# EAGLE board Mk4 Prototype (EAGLE 9.0.1), part 1 of 2 (continued)
## Placement (x,y rotation side) (continued)
FL1  DEA202450BT-1294C1-H  [DEA202450BT]  10.8,25.75 270 bottom
IC1  MSP432E401  [QFP128-0.4]  59.8,53 0 bottom
IC2  AS4C4M16SA-7TCN  [TSOP54-400]  38,52.7 270 bottom
IC3  TPS62822DLCR  [VSON-HR]  31.5,14.1 180 bottom
IC4  TCA9555RGER  [QFN-24]  78.05,26 270 bottom
IC5  SIM800C  [SIM800C]  100.3,41 180 bottom
IC6  SST26VF016B-104I/SM  [SO08-EIAJ]  72.5,43.15 270 bottom
IC7  TPD3E001DRL  [DRL-5]  69.8,69.25 180 bottom
IC8  BQ25601  [QFN-24]  41.05,24 270 bottom
IC9  OPT3001  [USON-6]  82.8,10.2 90 top
IC10  TPD3E001DRL  [DRL-5]  113.3,30.75 0 bottom
IC11  LMV358ID  [SO08]  79.8,54 180 bottom
IC12  SN74HC4066D  [SO14]  90.8,54.5 0 bottom
IC13  TPA2006D1  [VSON-8]  25.55,49 90 bottom
IC14  MX25R1635FM1IL0  [SO08-EIAJ]  12.05,40.25 90 bottom
IC15  CC3120R  [VQFN-64]  17.3,22.5 0 bottom
J1  78723-1001  [MSIM-MOLEX-LWK]  117.3,22.25 180 bottom
J2  ER-CON50HT-1  [FH12-50S-0.5SH]  59.8,33.5 0 bottom
J3  2x5 1.27mm  [PINHEAD_2X05_127]  89.7,62.2 0 bottom
J4  GSM-COIL-ANT  [GSM-ANTENNA]  116.3,36 0 bottom
J5  S2B-PH-SM4-TB(LF)(SN)  [JST-2-SMD]  88.6,15.8 90 bottom
JP2  1x03  [1X03_LOCK]  57.26,75.4 180 bottom
JP3  1x02 2MM  [1X02_2MM]  41.55,8.25 0 bottom
JP4  TC2030-MCP-NL  [TC2030-MCP-NL]  84.25,63.9 270 bottom
JP7  1x14  [1X14_LOCK]  2.05,59.5 270 bottom
JP8  1x04_1.27MM  [1X04-1.27MM]  10.55,14 180 top
JP9  1x04_1.27MM  [1X04-1.27MM]  113.3,49.5 0 bottom
L1  SRN2512-2R2M  [1008]  36.05,19.75 270 bottom
L2  BLM18KG121TN1D  [WUERTH-0805]  67.55,69.5 270 bottom
L3  0402/0R/5%  [L0402]  113.8,34.25 180 bottom
L4  DFE201610E-R47M=P2  [0806]  35.3,15.15 90 bottom
L5  0402/0R/5%  [L0402]  110.55,64 110 bottom
L6  0402/0R/5%  [L0402]  3.8,23 0 bottom
L7  LQM2HPN2R2MG0L  [1008]  14.3,33.2 180 bottom
L8  LQM2HPN1R0MG0L  [1008]  17.3,33.5 270 bottom
L9  LQM2HPN2R2MG0L  [1008]  23.8,32 270 bottom
LAYERS1  LAYER_NUMBRS_4_SMALL  [LAYER_NUMBERS_4_SMALL]  57.8,23.5 0 top
LCD  ER-TFT024-3  [ER-TFT024-3]  59.8,33.5 0 top
LED1  WS2812B  [WS2812B]  52.3,74 180 top
LED2  WS2812B  [WS2812B]  67.3,74 180 top
LED3  0603 RED  [LED-0603-CORRECT]  61.07,72 90 top
LED4  0603 GREEN  [LED-0603-CORRECT]  58.53,72 90 top
LED5  LED 5MM  [LED5MM]  33.8,10 0 top
LED6  0603 RED  [LED-0603-CORRECT]  43.55,28.75 180 bottom
LOGO1  EMFLOGO-BOTH  [EMFLOGO]  32.3,26 180 top
PCB  TiLDA Mk4 PCB  [TILDA_MK4_OUTLINE]  59.8,0 0 top
Q1  2N7002PW  [SC70-3-R]  90.3,29.5 90 bottom
Q2  2N7002PW  [SC70-3-R]  100.55,14 180 bottom
Q3  CSD25402Q3A  [Q3A]  39.55,15.75 0 bottom
Q8  CSD13202Q2  [Q2]  74.3,38.75 270 bottom
R1  0402/1K/5%  [R0402-SMALLER]  4.3,53 180 bottom
R2  0402/1K/5%  [R0402-SMALLER]  4.55,48 180 bottom
R3  0402/4K87/5%  [R0402-SMALLER]  49.8,57.25 0 bottom
R4  0402/10K/5%  [R0402-SMALLER]  58.3,65.25 180 bottom
R5  0402/1M/5%  [R0402-SMALLER]  49.8,59.25 0 bottom
R6  0402/2K/5%  [R0402-SMALLER]  63.55,63.75 90 bottom
R7  0402/1M/5%  [R0402-SMALLER]  65.3,72 270 bottom
R8  0402/100R/5%  [R0402-SMALLER]  70.8,67.25 270 bottom
R9  0402/10K/5%  [R0402-SMALLER]  67.3,44.25 270 bottom
R10  0402/10K/5%  [R0402-SMALLER]  77.8,41.75 90 bottom
R11  [0309/10]  23.3,12.25 180 top
R12  0402/2K/5%  [R0402-SMALLER]  61.07,72 270 bottom
R13  0402/10K/5%  [R0402-SMALLER]  37.55,15.25 90 bottom
R14  0402/4K7/5%  [R0402-SMALLER]  58.53,72 270 bottom
R15  0402/10K/5%  [R0402-SMALLER]  45.55,23.25 0 bottom
R16  0402/10K/5%  [R0402-SMALLER]  45.55,22.25 180 bottom
R17  0402/2K/5%  [R0402-SMALLER]  45.55,24.25 180 bottom
R18  0402/10K/5%  [R0402-SMALLER]  41.05,30.5 180 bottom
R19  0402/10K/5%  [R0402-SMALLER]  41.05,29.5 180 bottom
R20  0402/10K/5%  [R0402-SMALLER]  41.55,28 90 bottom
R21  0402/4K7/5%  [R0402-SMALLER]  45.85,48.25 90 bottom
R22  0402/4K7/5%  [R0402-SMALLER]  46.85,48.25 90 bottom
R23  0402/4K7/5%  [R0402-SMALLER]  99.05,11.75 90 bottom
R24  0402/4K7/5%  [R0402-SMALLER]  98.05,11.75 90 bottom
R25  0402/100K/5%  [R0402-SMALLER]  24.8,16.75 180 bottom
R26  0402/51R/5%  [R0402-SMALLER]  97.3,52.5 90 bottom
R27  0402/51R/5%  [R0402-SMALLER]  99.3,52.5 90 bottom
R28  0402/51R/5%  [R0402-SMALLER]  100.3,52.5 90 bottom
R29  0402/4K7/5%  [R0402-SMALLER]  97.8,30.5 0 bottom
R30  0402/100K/5%  [R0402-SMALLER]  88.3,29.5 90 bottom
R31  0402/1K/5%  [R0402-SMALLER]  89.8,41.25 180 bottom
R32  0402/1K/5%  [R0402-SMALLER]  89.8,42.25 180 bottom
R33  0402/1K/5%  [R0402-SMALLER]  89.8,39.25 180 bottom
R34  0402/1K/5%  [R0402-SMALLER]  89.8,38.25 180 bottom
R35  0402/1K/5%  [R0402-SMALLER]  89.8,37.25 180 bottom
R36  0402/1K/5%  [R0402-SMALLER]  89.8,33.25 180 bottom
R37  0402/1K/5%  [R0402-SMALLER]  89.8,35.25 180 bottom
R38  0402/5K6/5%  [R0402-SMALLER]  89.8,34.25 0 bottom
R39  0402/5K6/5%  [R0402-SMALLER]  89.8,36.25 0 bottom
R40  0402/5K6/5%  [R0402-SMALLER]  89.8,40.25 0 bottom
R41  0402/1K/5%  [R0402-SMALLER]  89.8,32.25 180 bottom
R42  0402/1K/5%  [R0402-SMALLER]  89.8,31.25 180 bottom
R43  0402/10K/5%  [R0402-SMALLER]  80.55,47 90 bottom
R44  0402/12R/5%  [R0402-SMALLER]  69.3,39 270 bottom
R45  0402/10K/5%  [R0402-SMALLER]  81.55,47 90 bottom
R46  0402/10K/5%  [R0402-SMALLER]  82.05,49.5 180 bottom
R47  0402/12R/5%  [R0402-SMALLER]  72.3,39 270 bottom
R48  0402/12R/5%  [R0402-SMALLER]  71.3,39 270 bottom
R49  0402/12R/5%  [R0402-SMALLER]  70.3,39 270 bottom
R50  0402/22K/5%  [R0402-SMALLER]  80.05,49.5 0 bottom
R51  0402/22K/5%  [R0402-SMALLER]  80.05,48.5 0 bottom
R52  0402/14K7/5%  [R0402-SMALLER]  79.8,59.75 180 bottom
R53  0402/7K87/5%  [R0402-SMALLER]  76.8,58.75 0 bottom
R54  0402/10K/5%  [R0402-SMALLER]  85.3,54.5 270 bottom
R55  0402/10K/5%  [R0402-SMALLER]  87.55,49.75 180 bottom
R56  0402/10K/5%  [R0402-SMALLER]  94.05,59.5 180 bottom
R57  0402/150K/1%  [R0402-SMALLER]  25.55,45.75 90 bottom
R58  0402/150K/1%  [R0402-SMALLER]  24.55,45.75 90 bottom
R59  0402/10K/5%  [R0402-SMALLER]  100.55,16 180 bottom
R60  0402/732K/5%  [R0402-SMALLER]  28.75,14.35 270 bottom
R61  0402/162K/5%  [R0402-SMALLER]  29.75,14.35 90 bottom
R62  0402/10K/5%  [R0402-SMALLER]  11.8,16.75 270 bottom
R63  0402/100K/5%  [R0402-SMALLER]  7.8,34.2 90 bottom
R64  0402/100K/5%  [R0402-SMALLER]  8.8,34.2 90 bottom
R65  0402/100K/5%  [R0402-SMALLER]  12.8,16.75 270 bottom
R66  0402/10K/5%  [R0402-SMALLER]  17.3,37.75 90 bottom
R67  0402/100K/5%  [R0402-SMALLER]  9.3,37.25 180 bottom
R68  0402/100K/5%  [R0402-SMALLER]  24.8,19.75 180 bottom
R69  0402/100K/5%  [R0402-SMALLER]  24.8,17.75 180 bottom
R70  0402/100K/5%  [R0402-SMALLER]  26.55,26.5 90 bottom
R71  0402/100K/5%  [R0402-SMALLER]  18.3,16.25 270 bottom
R72  0402/100K/5%  [R0402-SMALLER]  13.8,15 270 bottom
R73  0402/100K/5%  [R0402-SMALLER]  9.05,29 90 bottom
S1  SKPMAPE010  [SKPMAPE010-COMBINED]  87.8,53.5 0 top
S2  SKPMAPE010  [SKPMAPE010-COMBINED]  100.3,53.5 0 top
S3  SKPMAPE010  [SKPMAPE010-COMBINED]  112.8,53.5 0 top
S4  SKPMAPE010  [SKPMAPE010-COMBINED]  87.8,41 0 top
S5  SKPMAPE010  [SKPMAPE010-COMBINED]  100.3,41 0 top
S6  SKPMAPE010  [SKPMAPE010-COMBINED]  112.8,41 0 top
S7  SKPMAPE010  [SKPMAPE010-COMBINED]  87.8,28.5 0 top
S8  SKPMAPE010  [SKPMAPE010-COMBINED]  100.3,28.5 0 top
S9  SKPMAPE010  [SKPMAPE010-COMBINED]  112.8,28.5 0 top
S10  SKPMAPE010  [SKPMAPE010-COMBINED]  87.8,16 0 top
S11  SKPMAPE010  [SKPMAPE010-COMBINED]  100.3,16 0 top
S12  SKPMAPE010  [SKPMAPE010-COMBINED]  112.8,16 0 top
S13  SKPMAPE010  [SKPMAPE010-COMBINED]  10.6,48 135 top
S14  SKPMAPE010  [SKPMAPE010-COMBINED]  20.6,53 180 top
S15  SKPMAPE010  [SKPMAPE010-COMBINED]  30.6,48 45 top
S16  3X6X2.5  [TACTILE_SWITCH_SMD_3X6X2.5H]  29.8,68 15 top
S17  3X6X2.5  [TACTILE_SWITCH_SMD_3X6X2.5H]  89.8,68 345 top
S18  CUS-12TB  [SWITCH-SPST-SMD-A]  59.8,7.1 180 bottom
S19  3X6X2.5  [TACTILE_SWITCH_SMD_3X6X2.5H]  71.8,8.25 180 bottom
S20  3X6X2.5  [TACTILE_SWITCH_SMD_3X6X2.5H]  47.8,8.25 180 bottom
S22  AYZ0202AGRLC  [AYZ-JS-COMBINED]  99.8,67 287 bottom
SJ1  Amp Power Select  [SJ_3]  28.8,62 180 bottom
SW1  JOYSTICK  [JOYSTICK_MULTICOMP_NOSILK]  20.6,39 315 top
TP1  TP  [B1,27]  52.2,60.7 0 bottom
TP2  TP  [B1,27]  87.8,41.5 0 bottom
TP3  TP  [B1,27]  87.3,39.75 0 bottom
TP4  TP  [B1,27]  86.05,38.5 0 bottom
TP5  TP  [B1,27]  87.55,37.25 0 bottom
TP6  TP  [B1,27]  72.3,65.5 0 bottom
TP7  TP  [B1,27]  67.55,65.5 0 bottom
U1  ZX62-B-5PA(33)  [USB-AB-MICRO-SMD_LWK]  70.2,75.5 274 bottom
U2  TMP102  [SOT563]  74.8,21 270 bottom
U4  MIC-4MM  [MIC-SMD-4MM]  105.8,59 90 bottom
U5  LDMS1540S-01-R8-0.8-R  [SPEAKER-15MM-SMD]  15.8,53 90 bottom
X1  ABS07-32.768KHZ-T  [RESONATOR_EPSON_FC_145]  54.2,64.75 180 bottom
X2  ABM8G-25.000MHZ-B4Y-T  [CRYSTAL-3.2-2.5]  63.05,67.75 90 bottom
X3  ABS07-32.768KHZ-T  [RESONATOR_EPSON_FC_145]  25.8,22.75 90 bottom
X4  ABM8-40.000MHZ-10-1-U-T  [CRYSTAL-3.2-2.5]  8.6,19.25 270 bottom

## Tracks (layer width: path | path; a pad name or v marks a point on that pad's centre or on a via)
3V3  (via drill 0.3)
  Top 0.15: IC9.1 82.15,8.6 v82.3,8.45
  Top 0.3: SW1.COM 23.38,36.17 v22.3,37.25
  Bottom 0.15: v74.3,18.75 C102.1 73.55,19.5 73.3,19.75 73.3,20.75 73.55,21 U2.5 | v82.3,8.45 C104.1
  Bottom 0.2: IC1.9 62.8,43.75 C13.2 | IC1.8 63.2,46.4 v63.55,46.75 63.6,46.7 IC1.7 | IC1.16 60,43.8 C12.2 v60.3,42.75 | IC1.47 50.85,52.4 C10.2 | IC1.113 68.35,52.8 C9.2 | IC1.79 59.2,61.85 C11.2 | IC1.69 55.2,59.65 v55.05,59.5 54.8,59.75 IC1.68 | 20.55,27.28 IC15.47 | IC1.90 63.6,59.55 v63.55,59.5 | IC1.51 v50.8,54 51.2,54.4 IC1.52 | IC1.39 v53.3,49.2 | IC1.28 55.2,44.1 55.3,44 v55.55,44 55.8,44 56,44.2 IC1.26 | R9.1 v67.3,45.5 | IC1.101 66.45,57.6 v66.3,57.75 | IC1.122 66.35,49.2 v66.3,49.25
  Bottom 0.25: J2.41 52.05,38 | J2.40 52.55,37.5 52.05,38 | J2.42 51.55,37.5 52.05,38 | J2.35 v55.05,35.5 | J2.1 v72.05,35.5 | J2.8 v68.55,38 | J2.7 69.05,37.5 v68.55,38 | J2.9 68.05,37.5 v68.55,38 | C13.2 63.05,42.12 C14.2 63.3,41.62 v63.3,40.75 | v49.8,52.1 C10.2 | v70.05,53.75 C9.2 | v58.8,63 C11.2 | R4.2 v58.8,66 | R5.2 v48.55,59.25 | C89.1 19.55,28.5 19.05,28 IC15.44 | IC15.39 16.55,29.55 C90.1 | IC15.37 15.55,29.35 C88.1 | C91.1 v15.8,16.25 16.55,17 IC15.10 | C92.1 v23.8,23.5 23.55,23.75 IC15.54 | IC4.21 C21.2
  Bottom 0.3: 21.02,27.75 20.55,27.28 | R73.2 v9.05,30.25 | JP4.1 85.43,62.63 v85.8,63 | IC12.14 94.61,59.44 R56.2 94.55,60.25 C71.2 v94.8,61.5 | IC6.8 69.15,46.15 C2.2 v69.05,47 | v46.85,49.5 R22.2 R21.2 | C70.2 77.8,49.25 | 77.8,49.25 v77.8,48.75 | IC11.8 77.89,49.34 77.8,49.25 | R10.1 v77.8,40.5 | C28.2 43.73,42.25 IC2.27 43.63,42.25 v42.55,42.25 | v33.55,54.25 33.5,54.3 IC2.43 31.1,54.3 C24.2 | v33.55,59 33.45,59.1 IC2.49 31.15,59.1 C27.2 | v42.55,61.5 IC2.3 C22.2 | v42.55,63.25 42.7,63.1 IC2.1 44.95,63.1 C26.2 | v42.55,56.75 42.6,56.7 IC2.9 45,56.7 C23.2 | v42.55,52.75 42.6,52.7 IC2.14 45,52.7 C25.2 | R23.2 v99.05,13 | R24.2 v98.05,13 | C42.2 v25.8,34.5 | C42.2 26.55,35 v26.55,34.5 | C42.2 25.05,35 v25.05,34.5 | v78.8,49.5 R50.2 | C103.1 R60.1 | C88.1 v14.65,29.5
  Bottom 0.4: 21.02,27.75 22.4,27.75 C93.1 23.4,29.6 v23.8,30 | v21.05,29.75 21.05,29.25 20.5,28.7 C89.1 20.3,28.7 v20.3,29.75 | C90.1 16.9,29.7 v17.45,30.25 | v26.05,19.75 R68.2 | v26.05,17.75 R69.2 | R66.1 v16.55,37.25 C59.2 15.8,37.95 IC14.8 | R67.2 v10.55,37.25 | v74.3,26.5 C21.2 | v28.75,15.6 R60.1 | C43.2 v20.55,13 | C43.2 21.05,13.75 v20.55,13.75 | C43.2 21.05,12.25 v20.55,12.25
  Bottom 0.5: 28.8,62 SJ1.1 v26.8,62 | JP7.12 2.49,31.56 C4.2 | JP7.8 3.4,40.5 C3.2
  other vias: 52.3,41.25 32.95,20.15 33.75,20.15 33.35,20.65
  pour 3V3@2 (isolate 0.254, rank 6): 0,60 0,9 arc31 31.8,0 34.5,0 arc90 37.3,2.8 arc-90 39.3,4.8 80.3,4.8 arc-90 82.3,2.8 arc90 85.1,0 87.8,0 arc31 119.6,9 119.6,35 113.3,35 113.3,60 119.6,60 arc64 113.05,67.75 arc24 59.8,78 arc24 6.55,67.75 arc55
  pour Bottom (no thermals): 52.05,40 52.05,41.3 52.25,41.5 52.6,41.5 52.8,41.3 52.8,39.75 52.3,39.25 52.3,37.75 51.8,37.75 51.8,39.75
  pour Bottom (no thermals): 36.1,15.65 34.55,15.65 34,16.2 32.65,16.2 32.65,20.4 33.15,20.9 33.65,20.9 34.1,20.45 34.1,17.4 34.6,16.9 35.6,16.9 36.1,16.4
  pour Top: 22.3,33 15.8,33 14.3,31.5 14.3,27.5 14.8,27 21.3,27 25.8,31.5 25.8,32.5 27.3,34 27.3,34.5 26.8,35 24.3,35
3V3_POE
  Bottom 0.5: JP7.14 3.45,27.75 C5.2
!HIB
  Bottom 0.2: IC1.65 53.6,61.45 53.3,61.75 52.8,61.75 52.2,61.15 TP1.TP
!RESET  (via drill 0.3)
  Top 0.15: v68.3,25.5 71.6,28.8 74.6,28.8 75.8,30 75.8,30.7 76.5,31.4 76.5,42.4 80.92,46.83 82.66,46.83 83.2,47.37 83.2,47.78 82.58,48.4 80.8,48.4 77.6,51.6 v77.6,54.2 | v76.35,57.7 76.35,62.3 v79.4,65.35 76.47,68.28 72.2,68.28 71.72,67.8 69.94,67.8 69.47,68.28 69.03,68.28 68.56,67.8 59.6,67.8 v58.05,66.25
  Bottom 0.15: IC1.70 55.6,61.8 56.2,62.4 56.9,62.4 56.9,62.5 57.8,63.4 C15.2 | R4.1 57.8,66 v58.05,66.25 | S19.2 78.05,8.25 79.75,9.95 79.75,12.05 78.8,13 74.3,13 68.3,19 v68.3,25.5 | v77.6,54.2 76.35,55.45 v76.35,57.7
  Bottom 0.2: C15.2 R4.1 | J3.10 87.16,65.14 86.8,65.5 79.55,65.5 v79.4,65.35
!WAKE  (via drill 0.3)
  Top 0.15: v69.3,25.5 72.3,28.5 74.8,28.5 76.1,29.8 76.1,30.5 76.8,31.2 76.8,42.25 81.07,46.52 82.78,46.52 83.5,47.24 83.5,47.9 82.7,48.7 81,48.7 78.4,51.3 v78.4,54.2 | v77.1,57.7 77.1,61.9 80,64.8 80,65.8 77.2,68.6 72.1,68.6 | 72.1,68.6 68.93,68.6 68.67,68.33 | 72.1,68.6 71.6,68.1 70.07,68.1 69.59,68.58 68.91,68.58 68.43,68.1 53.2,68.1 v52.8,68.5
  Bottom 0.15: R5.1 50.3,59.75 50.05,60 48.8,60 48.3,60.5 48.3,63.06 48.32,63.08 48.32,63.52 47.87,63.98 47.58,63.98 47.56,64 47.3,64 46.8,64.5 46.8,65 47.8,66 50.3,66 v52.8,68.5 | S20.2 52.05,8.25 53.3,7 57.09,7 57.92,6.17 61.68,6.17 62.51,7 77.3,7 80.05,9.75 80.05,12.25 78.8,13.5 74.55,13.5 68.8,19.25 68.8,25 v69.3,25.5 | v78.4,54.2 77.1,55.5 v77.1,57.7
  Bottom 0.2: IC1.64 50.35,59.2 R5.1
AIN0_ADC_X  (via drill 0.3)
  Top 0.15: v48.9,39.1 50.5,37.5 54.9,37.5 56.67,39.27 56.67,40.42 57,40.74 v57,41
  Bottom 0.15: IC1.13 61.2,43.4 60.82,43.02 60.82,42.53 60.5,42.21 60.5,40.8 60.7,40.6 60.7,39.6 60.2,39.1 58.3,39.1 57.9,39.5 57.9,40.7 57.6,41 v57,41 | v48.9,39.1 49.57,38.42 49.57,37.78 49.55,37.76 J2.46
AIN1_ADC_Y  (via drill 0.3)
  Top 0.15: v49.05,38 49.85,37.2 55.1,37.2 57.2,39.3 v57.2,40.2
  Bottom 0.15: J2.47 v49.05,38 | IC1.12 61.6,43.97 61.52,43.89 61.52,43.23 61.12,42.83 61.12,42.41 60.8,42.08 60.8,41 61.1,40.7 61.1,39.5 60.4,38.8 57.7,38.8 57.2,39.3 v57.2,40.2
AIN4_SPK_ADC  (via drill 0.3)
  Top 0.15: v75.5,53.4 76.1,53.4 76.6,52.9 76.6,51.6 74.1,49.1 70.5,49.1 70.4,49.2 69.7,49.2 69.4,48.9 69.4,48.4 69.8,48 v70.6,48
  Bottom 0.15: R46.2 82.55,52.25 81.8,53 79.55,53 79.16,52.62 | IC11.7 79.16,52.62 | 79.16,52.62 79.16,52.63 78.4,53.4 v75.5,53.4 | IC1.128 68.3,46.8 68.5,47 68.5,47.2 69.3,48 v70.6,48
AIN5_CH3  (via drill 0.3)
  Top 0.15: PCB.CH2 22,8.4 23.4,9.8 25.4,9.8 27.2,11.6 27.2,13.68 28.2,14.68 28.2,16.25 29.1,17.15 29.1,20 32.1,23 32.1,27.75 36.45,32.1 44.3,32.1 45.5,30.9 60.3,30.9 62.6,33.2 62.6,36.7 64.42,38.52 64.42,41.22 64.4,41.24 64.4,41.5 63.7,42.2 63.7,45.73 64.38,46.41 64.38,46.77 v64.8,47.2
  Bottom 0.15: IC1.127 66.5,47.2 65.9,46.6 65.1,46.6 64.8,46.9 v64.8,47.2
AMP_IN_N
  Bottom 0.2: R58.2 24.57,46.27 IC13.4
AMP_IN_P
  Bottom 0.2: R57.2 25.22,46.58 IC13.3
AMP_IN_R_N
  Bottom 0.2: R58.1 C82.1
AMP_IN_R_P
  Bottom 0.2: R57.1 C83.1
AMP_VDD  (via drill 0.3)
  Top 0.22: v25.3,52 25.59,51.71 26.31,51.71 26.66,51.36 26.66,48.77 24.29,46.4 24.29,46.02 25.44,44.88 25.65,44.88 26.03,45.25 v26.55,45.25
  3V3@2 0.5: v28.8,60.75 26.3,58.25 26.3,55.5 25.3,54.5 v25.3,52
  Bottom 0.25: IC13.1 26.52,45.27 v26.55,45.25 | IC13.6 25.22,51.92 v25.3,52 C58.1
  Bottom 0.5: SJ1.2 v28.8,60.75
BQ_!CE
  Bottom 0.15: R17.1 IC8.9
BQ_!INT  (via drill 0.3)
  Top 0.15: v52.7,34.5 53.3,33.9 55.98,33.9 59.6,37.52 59.6,38.82 60.1,39.32 60.1,40.2 58,42.3 58,43.9 60.17,46.08 60.42,46.08 60.8,46.46 v60.8,47.2
  Bottom 0.15: IC8.7 43.8,25.25 44.3,25.75 44.3,26.1 44.5,26.3 45.6,26.3 46.5,25.4 51.9,25.4 52.7,26.2 v52.7,34.5 | v60.8,47.2 IC1.14
BQ_!QON  (via drill 0.3)
  Top 0.15: v44.05,22.7 46.35,25 47.05,25 47.55,24.5 47.55,17 45.8,15.25 45.8,13 45.45,12.65 39.55,12.65 v38.05,11.15
  Bottom 0.15: IC8.12 44,22.75 v44.05,22.7 | JP3.2 38.05,9.75 v38.05,11.15
BQ_PMID
  Bottom 0.3: IC8.23 38.22,24.75
  Bottom 0.4: C36.1 37.1,25.04 37.92,25.04 38.22,24.75
BQ_PSEL
  Bottom 0.15: IC8.2 40.3,29.25 R19.1 R18.1
BQ_REGN  (via drill 0.3)
  Top 0.2: v37.8,24.25 37.8,22.75 38.8,21.75 46.3,21.75 v46.8,22.25
  Bottom 0.25: IC8.22 v37.8,24.25
  Bottom 0.3: R16.2 v46.8,22.25
  Bottom 0.4: C39.2 v37.8,24.25
BQ_STAT
  Bottom 0.15: IC8.4 41.3,27.25 R20.1
BQ_STAT_R
  Bottom 0.15: LED6.C 41.8,28.75 R20.2
BQ_SW
  pour Bottom (no thermals): 39.3,23.3 38.1,23.3 37.5,22.7 36.6,22.7 36.3,23 36.3,23.45 35.85,23.45 34.95,22.55 34.95,20.5 37.1,20.5 37.8,21.2 37.8,22 38.5,22.7 39.3,22.7
BQ_TS
  Bottom 0.15: R16.1 R15.2 IC8.11
BT_ANT
  Bottom 0.4: IC5.20 103.6,51 arc-90 106.6,54 107.05,54 arc90 109.05,56 109.05,58.5 arc-21 109.8,62 arc-6 C74.2 arc-6 L5.1
BT_ANT_L
  Bottom 0.4: L5.2 arc-10 C75.2 111.08,65.72 arc85 110.8,66.25 arc15 ANT2.1
BTN_1  (via drill 0.3)
  Top 0.2: S1.B2 93.7,54.4 93.7,47.15 92.81,46.25 83.11,46.25 83.03,46.17 81.38,46.17 79.35,44.15 79.35,36.67 77.12,34.45 77.12,30.9 76.45,30.22 v76.45,28.85
  Top 0.3: S1.2 92.35,55.05 S1.B2 S1.B1
  Bottom 0.15: IC4.1 76.8,28.5 v76.45,28.85
BTN_2  (via drill 0.3)
  Top 0.2: S2.2 103.3,46.5 102.3,45.5 95.28,45.5 95.23,45.55 83.4,45.55 83.32,45.48 81.72,45.48 80.05,43.8 80.05,36.38 77.9,34.23 77.9,30.4 v77.5,30
  Top 0.3: S2.2 104.85,55.05 S2.B2 103.15,55.75 102.55,55.15 101.05,55.15 100.45,55.75 S2.B1
  Bottom 0.15: IC4.3 77.8,29.7 v77.5,30
BTN_3  (via drill 0.3)
  Top 0.2: S3.B1 106.8,54.3 106.8,46.5 105.3,45 95.29,45 95.09,45.2 83.55,45.2 83.47,45.12 81.87,45.12 80.4,43.66 80.4,36.24 78.3,34.14 78.3,30.3 v78.6,30
  Top 0.3: S3.2 117.35,55.05 S3.B2 S3.B1
  Bottom 0.15: IC4.4 78.3,29.7 v78.6,30
BTN_4  (via drill 0.3)
  Top 0.2: S4.B1 82.05,43.25 81.5,42.7 81.5,31.2 81.5,31 81.5,28.3 v81.1,27.9
  Top 0.3: S4.2 92.35,42.55 S4.B2 91.15,43.25 90.55,42.65 89.05,42.65 88.45,43.25 S4.B1
  Bottom 0.15: IC4.7 80.45,27.25 v81.1,27.9
BTN_5  (via drill 0.3)
  Top 0.2: S5.B1 95.75,43.55 94.8,44.5 83.83,44.5 83.76,44.42 82.16,44.42 81.15,43.41 81.15,36 79.1,33.95 79.1,30.77 79.65,30.22 v79.65,28.85
  Top 0.3: S5.2 104.85,42.55 S5.B2 S5.B1
  Bottom 0.15: IC4.6 79.3,28.5 v79.65,28.85
BTN_6  (via drill 0.3)
  Top 0.2: S6.B2 113.08,43.25 113.03,43.3 112.57,43.3 112.52,43.25 S6.B1 107,44.5 95.29,44.5 94.94,44.85 83.69,44.85 83.61,44.77 82.02,44.77 80.8,43.56 80.8,36.15 78.7,34.05 78.7,30.68 79.15,30.23 79.15,29.77 79.1,29.72 v79.1,29.4
  Top 0.3: S6.2 117.35,42.55 S6.B2
  Bottom 0.15: IC4.5 78.8,29.1 v79.1,29.4
BTN_7  (via drill 0.3)
  Top 0.2: v81.43,27.17 83.25,28.99 S7.B1
  Top 0.3: S7.2 92.35,30.05 S7.B2 S7.B1
  Bottom 0.15: IC4.8 80.77,26.75 80.82,26.8 81.06,26.8 v81.43,27.17
BTN_8  (via drill 0.3)
  Top 0.2: S8.2 103.3,23.75 102.25,22.7 94.1,22.7 93.3,21.9 87.5,21.9 86.2,21.9 85.2,21.9 v81.7,25.4
  Top 0.3: S8.2 104.85,30.05 S8.B2 S8.B1
  Bottom 0.15: IC4.10 80.81,25.75 80.83,25.73 81.38,25.73 v81.7,25.4
BTN_9  (via drill 0.3)
  Top 0.2: S9.B2 116.33,30.75 113.78,28.2 112.67,28.2 110.12,30.75 S9.B1 108.25,28.35 106.95,27.05 106.95,24.15 105.1,22.3 94.19,22.3 93.44,21.55 87.6,21.55 85.66,21.55 84.55,21.55 v81.6,24.5
  Top 0.3: S9.2 117.35,30.05 S9.B2
  Bottom 0.15: IC4.11 80.85,25.25 v81.6,24.5
BTN_10  (via drill 0.3)
  Top 0.2: S10.B2 92.35,19.7 91.65,20.4 82.3,20.4 81.3,20.4 | 81.2,20.4 81.3,20.4 | v79.2,22.5 81.3,20.4
  Top 0.3: S10.2 92.35,17.55 S10.B2 S10.B1
  Bottom 0.15: IC4.14 78.8,23.1 79.2,22.7 v79.2,22.5
BTN_11  (via drill 0.3)
  Top 0.2: S11.B2 104.85,20.65 103.9,21.6 94.5,21.6 93.7,20.8 82,20.8 v79.65,23.15
  Top 0.3: S11.2 104.85,17.55 S11.B2 S11.B1 | S11.B1 95.55,18.25 95.3,18 95.5,18 S11.B1
  Bottom 0.15: IC4.13 79.3,23.5 v79.65,23.15
BTN_12  (via drill 0.3)
  Top 0.2: S12.B1 104.55,21.95 94.34,21.95 93.59,21.2 84,21.2 v80.8,24.4
  Top 0.3: S12.2 117.35,17.55 S12.B2 S12.B1
  Bottom 0.15: IC4.12 80.45,24.75 v80.8,24.4
BTN_A  (via drill 0.3)
  Top 0.15: v77.8,22.1 76.9,21.2 70.6,21.2 63.3,28.5 49.9,28.5 v48.8,27.4 | v21,41.4 21,43.8 20.4,44.4 13.43,44.4 S13.B1
  Top 0.3: S13.2 7.98,49.63 S13.B2 S13.B1
  Bottom 0.15: IC4.16 v77.8,22.1 | v48.8,27.4 48.2,27.4 45.7,29.9 44.7,29.9 39.2,35.4 30.62,35.4 28.72,37.3 24.32,37.3 22.72,38.9 21.8,38.9 21,39.7 v21,41.4
BTN_B  (via drill 0.3)
  Top 0.15: v77.2,22.6 76.1,21.5 70.8,21.5 63.45,28.85 49.45,28.85 v48.8,28.2 | 31.28,46.7 31.28,37.58 v31,37.3
  Top 0.2: S15.B1 27.87,48.45 28.57,48.45 30.32,46.7 31.28,46.7 31.6,47.02 31.6,49 S15.2
  Top 0.3: S15.2 32.72,52.31 S15.B2
  Bottom 0.15: IC4.17 77.3,22.7 v77.2,22.6 | v48.8,28.2 47.82,28.2 45.82,30.2 44.82,30.2 39.32,35.7 34.3,35.7 34.2,35.7 31.9,35.7 31,36.6 v31,37.3
BTN_CALL  (via drill 0.3)
  Top 0.15: S16.2 30.56,66 28.3,66 28.1,65.8 12.18,65.8 4,57.62 4,48.38 4.9,47.48 5.82,47.48 11.7,41.6 13.3,41.6 15.8,44.1 20.2,44.1 20.4,43.9 v20.4,42 | v78.45,22.6 78.45,21.85 77.5,20.9 70.4,20.9 63.1,28.2 50.4,28.2 v49.6,27.4
  Bottom 0.15: IC4.15 78.3,22.75 v78.45,22.6 | v49.6,27.4 49,26.8 48.3,26.8 45.5,29.6 44.5,29.6 39,35.1 30.5,35.1 28.6,37 24.2,37 22.6,38.6 21.2,38.6 20.4,39.4 v20.4,42
BTN_END  (via drill 0.3)
  Top 0.2: S17.2 93.57,56.98 94.05,56.5 94.05,47 92.95,45.9 83.25,45.9 83.18,45.83 81.53,45.83 79.7,44 79.7,36.53 77.5,34.33 77.5,30.78 76.95,30.23 76.95,29.77 77,29.72 v77,29.4
  Bottom 0.15: IC4.2 77.3,29.1 v77,29.4
BTN_MENU  (via drill 0.3)
  Top 0.15: S14.B2 16.05,53.18 14.77,54.46 14.77,62.98 16.3,64.5 v47.8,64.5
  Top 0.3: S14.2 17.6,52.3 S14.B2 22.8,50.75 23.05,51 23.55,51 23.8,50.75 S14.B1
  Bottom 0.15: IC1.60 53.12,57.6 53.6,58.08 53.6,59.5 53.27,59.83 51.38,59.83 51.12,60.08 51.12,60.34 50.64,60.83 49.32,60.83 49.12,61.02 49.12,64.32 48.82,64.62 48.38,64.62 48.26,64.5 v47.8,64.5
BTST
  Bottom 0.15: IC8.21 38.34,23.75 37.84,23.25 C37.1
CC_!HIB  (via drill 0.3)
  Top 0.15: v30.8,31.2 33.01,31.2 35.71,33.9 45.4,33.9 46.6,32.7 56.48,32.7 60.8,37.02 60.8,38.1 61.3,38.6 61.3,39.2 61.7,39.6 63.1,39.6 63.82,40.33 63.82,40.97 63.8,40.99 63.8,41.25 63.1,41.95 63.1,46.46 63.02,46.53 63.02,46.97 63.1,47.04 63.1,47.5 v63.9,48.3
  Bottom 0.15: IC15.2 20.55,17.5 20.56,17.5 21.31,16.75 R25.1 24.82,16.23 26.27,16.23 26.57,16.53 26.57,18.88 26.6,18.9 26.6,19.32 28.9,21.62 28.9,29.3 v30.8,31.2 | v63.9,48.3 64.12,48.52 64.82,48.52 64.94,48.4 IC1.124
CC_!RESET  (via drill 0.3)
  Top 0.15: v62.55,48.5 61.85,49.2 60.7,49.2 60.2,48.7 60.2,48.23 60.7,47.73 61.02,47.73 61.32,47.42 61.32,46.98 61.1,46.76 61.1,46.33 60.54,45.77 60.38,45.77 58.3,43.7 58.3,42.48 60.4,40.38 60.4,39.2 59.9,38.7 59.9,37.39 56.11,33.6 47.3,33.6 46.1,34.8 35.33,34.8 33.13,32.6 30.4,32.6 30.1,32.3 28.9,32.3 28.4,32.8 28.4,33.9 26.9,35.4 24.92,35.4 23.92,34.4 23.53,34.4 23.12,33.98 22.79,33.98 21.17,35.6 19.2,35.6 18,34.4 10.4,34.4 10.1,34.7 8.5,34.7 7.2,33.4 7.2,31.04 7.27,30.96 7.27,29.77 8.05,29 v8.05,27.5
  Bottom 0.15: v62.55,48.5 62.6,48.5 62.77,48.67 62.77,48.82 63.45,49.5 63.55,49.5 64.85,50.8 IC1.118
  Bottom 0.2: IC15.32 12.55,26.25 12.05,26.75 12.05,27.75 11.3,28.5 R73.1 C60.2 v8.05,27.5
CC_!RTS
  Bottom 0.2: IC15.50 23.05,25.75 23.6,25.2 26.03,25.2 26.35,25.52 26.35,25.8 R70.1
CC_IRQ  (via drill 0.3)
  Top 0.15: v14.05,17.44 15.27,16.21 15.27,16.03 16.83,14.47 18.52,14.47 18.69,14.65 26.45,14.65 27.2,15.4 27.2,16.62 27.9,17.32 27.9,18.9 28.2,19.2 28.2,20.42 30.36,22.59 30.36,26.44 36.33,32.4 44.5,32.4 45.7,31.2 60.1,31.2 62.3,33.4 62.3,36.9 64.12,38.73 64.12,41.09 64.1,41.12 64.1,41.38 63.4,42.08 63.4,45.86 64.08,46.53 64.08,47.48 v64.6,48
  Bottom 0.15: R72.1 14.05,15.75 v14.05,17.44 IC15.15 | IC1.123 66.59,48.8 66.52,48.73 66.08,48.73 65.91,48.9 63.7,48.9 63.38,48.58 63.38,48.02 63.7,47.7 64.3,47.7 v64.6,48
CC_RCT_XTAL_N
  Bottom 0.25: C100.2 25.85,21.25 X3.P$1 24.85,21.2 24.55,21.5 24.55,23.65 23.8,24.4 23.15,24.4 22.8,24.75 IC15.52
CC_RESERVED@19
  Bottom 0.15: IC15.19 12.45,19.75 12.27,19.57 12.27,18.53 12.8,18.01 R65.1
CC_RTC_XTAL_P
  Bottom 0.25: C101.2 25.85,24.25 X3.P$2 24.5,24.3 23.97,24.82 23.45,24.82 23.02,25.25 IC15.51
CC_WLAN_XTAL_
  Bottom 0.15: X4.3 7.67,18.32 8.6,19.25 10.25,19.25 C99.2 11.15,18.75 11.67,19.27 11.67,20.55 12.38,21.25 IC15.22
CC_WLAN_XTAL_P
  Bottom 0.15: X4.1 10.17,19.75 C98.2 11.1,19.75 11.38,20.02 11.38,20.75 12.38,21.75 IC15.23
CH4  (via drill 0.3)
  Top 0.15: PCB.CH1 28.18,10.82 27.5,11.5 27.5,13.55 | 27.5,13.55 | 27.5,13.55 29.35,15.4 29.35,16.94 29.4,16.99 29.4,19.88 32.4,22.88 32.4,27.62 36.58,31.8 44.1,31.8 45.3,30.6 60.5,30.6 62.9,33 62.9,36.4 64.72,38.23 64.72,41.34 64.7,41.37 64.7,41.7 64,42.4 64,45.6 v65.6,47.2
  Bottom 0.15: v65.6,47.2 66,47.6 IC1.126
DCDC_ANA_SW
  Bottom 0.25: 16.05,30.7 IC15.38
  Bottom 0.4: L7.2 15.4,31.8 16.05,31.15 16.05,30.7
DCDC_DIG_SW
  Bottom 0.25: IC15.43 18.55,28.2 19.65,29.3 19.65,30.1 20.3,30.75 23.65,30.75 L9.2
DCDC_PA_SW_N
  Bottom 0.25: IC15.41 17.55,28.7 18.55,29.7
  Bottom 0.3: 18.55,29.7 18.55,29.76 18.8,30.01 18.8,32 18.9,32.1
  Bottom 0.5: 18.9,32.1 18.9,33.8 18.1,34.6 L8.1
DCDC_PA_SW_P
  Bottom 0.25: IC15.40 17.05,28.97 18.05,29.97 18.25,30.17
  Bottom 0.4: L8.2 18.25,32.4 18.25,30.17
EN0RXI_N
  Bottom 0.22: JP7.13 5.32,29.02 6.3,30 6.3,35.94 6.23,36 6.23,42.92 6.63,43.31 20.47,43.31 22.97,40.81 29.47,40.81 30.97,39.31 47.63,39.31 48.98,40.67 48.98,53.92 49.88,54.81 51.2,54.81 51.21,54.8 IC1.53
EN0RXI_P
  Bottom 0.22: JP7.11 4.4,34.1 5.8,35.5 5.8,35.94 5.86,36 5.86,43.08 6.47,43.69 20.63,43.69 23.13,41.19 29.63,41.19 31.13,39.69 47.47,39.69 48.61,40.83 48.61,54.08 49.72,55.19 51.2,55.19 51.21,55.2 IC1.54
EN0TXO_N
  Bottom 0.22: JP7.7 2.98,45.31 7.72,45.31 8.72,44.31 21.22,44.31 23.72,41.81 29.72,41.81 31.22,40.31 46.88,40.31 47.98,41.42 47.98,54.42 49.58,56.02 51.2,56.02 51.21,56 IC1.56
EN0TXO_P
  Bottom 0.22: JP7.6 3.29,45.69 7.88,45.69 8.88,44.69 21.38,44.69 23.88,42.19 29.88,42.19 31.38,40.69 46.72,40.69 47.61,41.58 47.61,54.58 49.42,56.38 51.2,56.38 51.21,56.4 IC1.57
ETHLED0  (via drill 0.3)
  Top 0.15: v5.8,53 5.8,59 12.3,65.5 47.97,65.5 49.12,64.34 49.12,63.88 48.82,63.58 48.38,63.58 48.36,63.6 48.1,63.6 v47.8,63.3
  Bottom 0.15: R1.2 v5.8,53 | IC1.63 50.8,58.8 50.7,58.7 48.2,58.7 47.9,59 47.9,63.2 v47.8,63.3
ETHLED0_R
  Bottom 0.2: JP7.3 3.34,53 R1.1
ETHLED1  (via drill 0.3)
  Top 0.15: v6.3,48 4.8,48 4.3,48.5 4.3,51.5 4.8,52 5.8,52 6.32,52.52 6.32,59.02 12.4,65.1 47.94,65.1 48.6,64.44 v48.6,64.1
  Bottom 0.15: R2.2 v6.3,48 | IC1.61 53.1,58 53.3,58.2 53.3,59.3 53.07,59.52 51.17,59.52 50.82,59.88 50.82,60.22 50.52,60.52 49.2,60.52 48.7,61.02 48.7,63.62 48.42,63.9 48.42,63.92 v48.6,64.1
ETHLED1_R
  Bottom 0.2: JP7.5 3.26,48 R2.1
FET
  Bottom 0.15: 79,38.3 79,43.12 77.21,44.91 77.21,45.45 77.08,45.59 76.57,45.59 76.05,46.1 74.45,46.1 73.6,46.95 73.6,51.95 71.15,54.4 69.37,54.4 69.27,54.3 68.92,54.3 68.62,54 IC1.110
  Bottom 0.2: R59.1 98.55,17.5 88.59,17.5 83.3,22.8 83.3,34 79,38.3
  Bottom 0.3: Q2.1 100.05,15.07 R59.1
FET_OUT
  Top 0.5: LED5.K 38.55,6.53 57.32,6.53 57.84,6 61.76,6 62.26,6.5 83.8,6.5 87.3,10 107.61,10 PCB.FET
  Bottom 0.5: PCB.FET 106.11,11.5 101.8,11.5 100.55,12.75 Q2.3
FLASH_!CS  (via drill 0.3)
  Top 0.15: v13.55,12.5 14.32,13.28 14.32,15.15 12.62,16.85 12.62,17.32 8.35,21.6 8.35,24.75 6.3,26.8 6.3,29.05 6.07,29.28 6.07,30.47 6,30.54 6,33.9 6.3,34.2 6.3,36.2 8.77,38.67 9.97,38.67 v10.8,39.5
  Bottom 0.15: JP8.2 9.28,12.02 9.8,11.5 12.55,11.5 v13.55,12.5 14.38,13.32 14.38,17.02 14.57,17.22 14.57,17.66 14.55,17.68 IC15.14
  Bottom 0.2: R67.1 8.8,38.22 IC14.1 9.64,38.34 v10.8,39.5
FLASH_CLK  (via drill 0.3)
  Top 0.15: v13.05,40.25 13.05,38.75 12.07,37.77 9.15,37.77 7.2,35.83 7.2,33.82 6.9,33.52 6.9,30.91 6.97,30.84 6.97,29.65 7.2,29.43 7.2,27.35 9.25,25.3 9.25,21.97 13.52,17.7 13.52,17.22 15.27,15.47 15.27,13.03 v15.8,12.5 15.8,12 14.8,11 9.8,11 8.01,12.79 JP8.3
  Bottom 0.15: v15.8,12.5 15.27,13.03 15.27,16.65 16.05,17.42 IC15.11
  Bottom 0.2: IC14.6 13.68,40.88 v13.05,40.25
FLASH_MISO  (via drill 0.3)
  Top 0.15: v10.8,40.5 11,40.5 11.7,39.8 11.7,38.8 11.27,38.38 8.9,38.38 6.6,36.08 6.6,34.07 6.3,33.77 6.3,30.67 6.38,30.59 6.38,29.4 6.6,29.18 6.6,26.93 8.65,24.88 8.65,21.72 12.92,17.45 12.92,16.97 14.62,15.27 14.62,12.82 v14.3,12.5 14.3,12 13.8,11.5 11.3,11.5 10.55,12.25 JP8.1
  Bottom 0.15: 14.3,12.6 v14.3,12.5 14.3,12.83 14.67,13.2 14.67,16.9 15.05,17.27 IC15.13
  Bottom 0.2: IC14.2 9.91,39.62 v10.8,40.5
FLASH_MOSI  (via drill 0.3)
  Top 0.15: v15.05,12.5 14.92,12.62 14.92,15.4 13.22,17.1 13.22,17.57 8.95,21.85 8.95,25 6.9,27.05 6.9,29.3 6.67,29.53 6.67,30.72 6.6,30.79 6.6,33.65 6.9,33.95 6.9,35.95 9.02,38.08 11.88,38.08 12.5,38.7 12.5,40.95 v12.55,41
  Bottom 0.15: 14.97,12.57 v15.05,12.5 | JP8.4 6.74,13.56 9.3,11 13.54,11 14.82,12.28 14.82,12.43 14.97,12.57 | 14.97,12.57 14.97,16.77 15.55,17.35 IC15.12
  Bottom 0.2: IC14.5 13.7,42.16 v12.55,41
FLASH_PU
  Bottom 0.15: IC14.3 10.18,40.88 10.32,41.02 11.02,41.02 11.04,41 11.55,41 12.05,40.5 12.05,39.75 12.18,39.62 IC14.7
  Bottom 0.2: IC14.7 16.68,39.62 17.3,39 R66.2
GMS_ANT_L
  Bottom 0.4: J4.ANT D2.1 C73.2 L3.2
GND  (via drill 0.3)
  Top 0.15: IC9.3 83.45,9.2 | 83.45,9.2 83.45,8.55 v83.55,8.45 | IC9.2 83.4,9.25 83.45,9.2 | v82.3,10.2 IC9.PAD v83.3,10.2
  Top 0.3: S8.1 95.75,26.95 S8.A1 | S7.A1 83.25,26.95 S7.1 v86.3,28.5 | S10.A1 83.25,14 83.5,13.75 v84.8,13.75 S10.1 | S12.1 108.25,14.45 S12.A1 | S9.A1 108.25,26.95 S9.1 110.3,28.5 v111.3,27.5 | 108.25,51.5 108.25,51.95 S3.1 v111.3,53.5 | 108.25,51.5 S3.A1 | S2.A1 95.75,51.95 S2.1 97.8,54 v98.8,54 | S1.A1 83.25,51.95 S1.1 86.05,53.5 v86.3,53.25 | S4.A1 83.25,39.45 S4.1 v86.3,41 | 95.75,39 95.75,39.45 S5.1 v98.8,41 | 95.75,39 S5.A1 | S14.1 24.95,54.35 24.95,55.05 S14.A1 25.15,55 24.9,55.25 v20.55,55.25 S14.A2 | S1.A2 92.35,52.8 v92.55,53 | 108,51.25 108.25,51.5 | S6.A2 v112.8,38.75 | v111.3,41 S6.1 108.25,39.45 S6.A1 S5.A2 | 92.3,26.3 S7.A2 90.3,26.25 v89.8,26.75 | S8.1 96.8,29 | S12.A2 117.3,13.75 117.3,13.25 v118.05,12.5 | S11.A2 S12.A1 | v98.8,16 S11.1 95.75,14.45 S11.A1 S10.A2 | S4.A2 95.5,38.75 95.75,39 | S17.1 85.29,69.01 v84.8,69.5 | LED3.C 60.5,71.25 v59.8,70.55 59.1,71.25 LED4.C | LED1.3 49.75,75.5 v48.55,75.5 | v64.45,76.85 64.85,76.45 LED2.3 | S3.A2 113.3,51.25 v112.8,50.75 | S13.A1 15.41,46.39 v14.3,47.5 14.3,47.46 S13.1 | S13.A2 9.91,53.75 v10.05,53.75 | S15.1 29.86,44.5 v30.05,44.5 30.05,44.27 S15.A1 | S15.A2 36.53,50.75 v36.55,50.75 | S16.1 25.29,66.99 v24.8,66.5 | S12.A1 v109.8,13.75 | S9.A2 117.3,26.2 v117.3,25 | S2.A2 104.85,50.7 v105.8,49.75 | S8.1 97.05,28.75 v95.8,28.75 | S8.A2 105.3,25.8 v105.3,25
  GND@3 0.4: v22.25,28.85 19.6,26.2 v19.6,25.85 | v17.3,31.5 16.55,30.75 16.55,26.6 v17.3,25.85 | v14.8,31.1 15.55,30.35 15.55,26.4 v16.1,25.85